# EAGLE board BMS-HVver3 (EAGLE 6.6.0), part 1 of 2
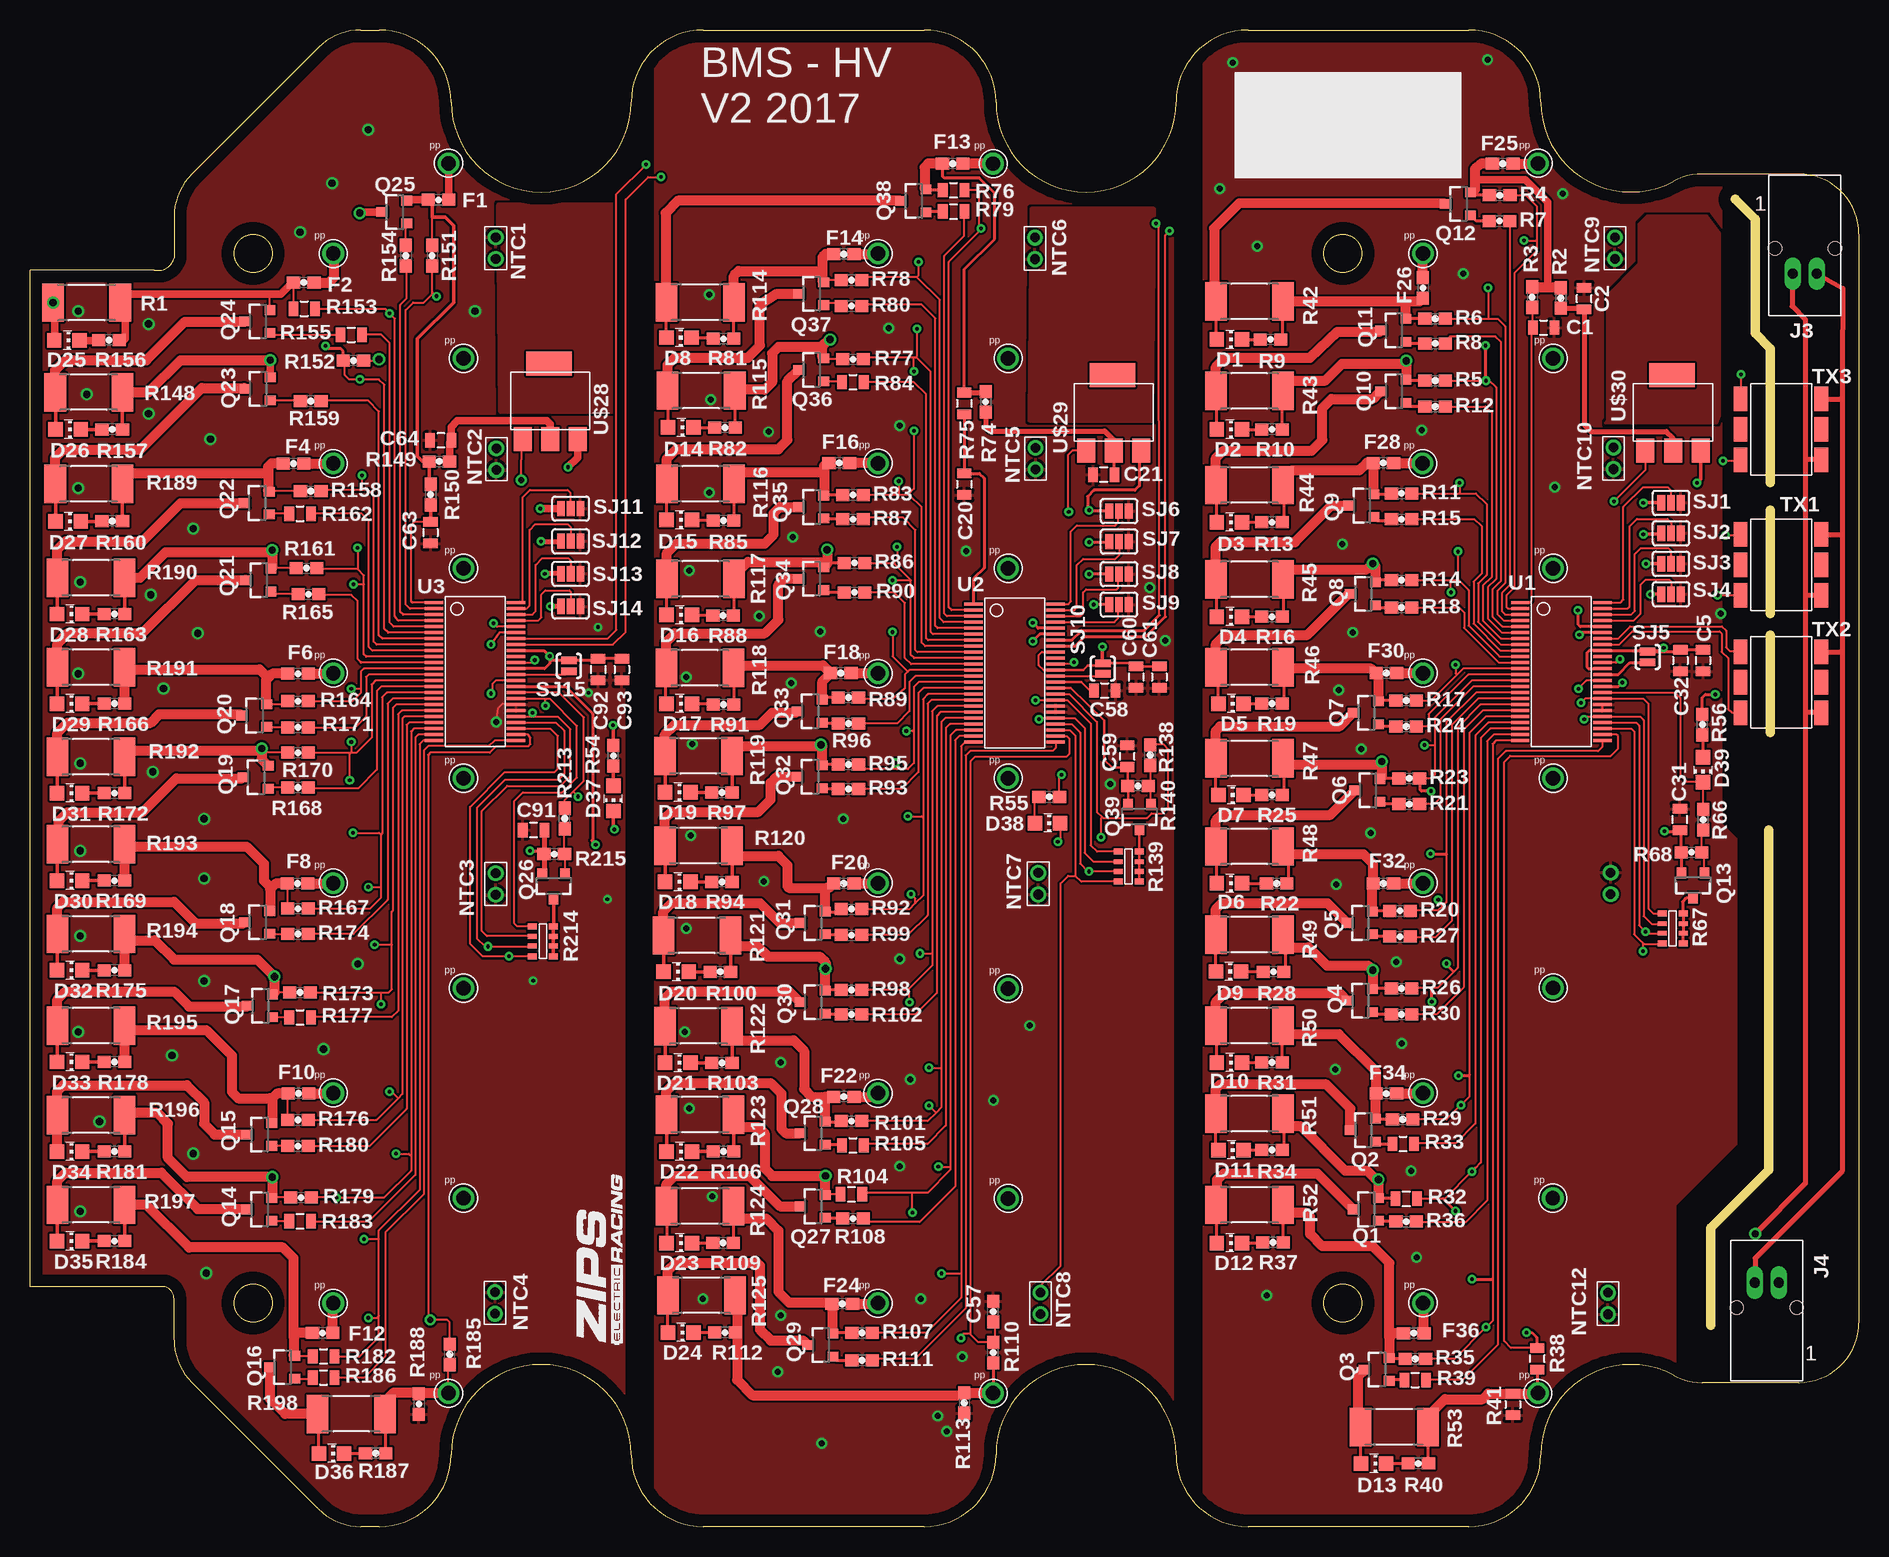
[diagram p3: board, top side]
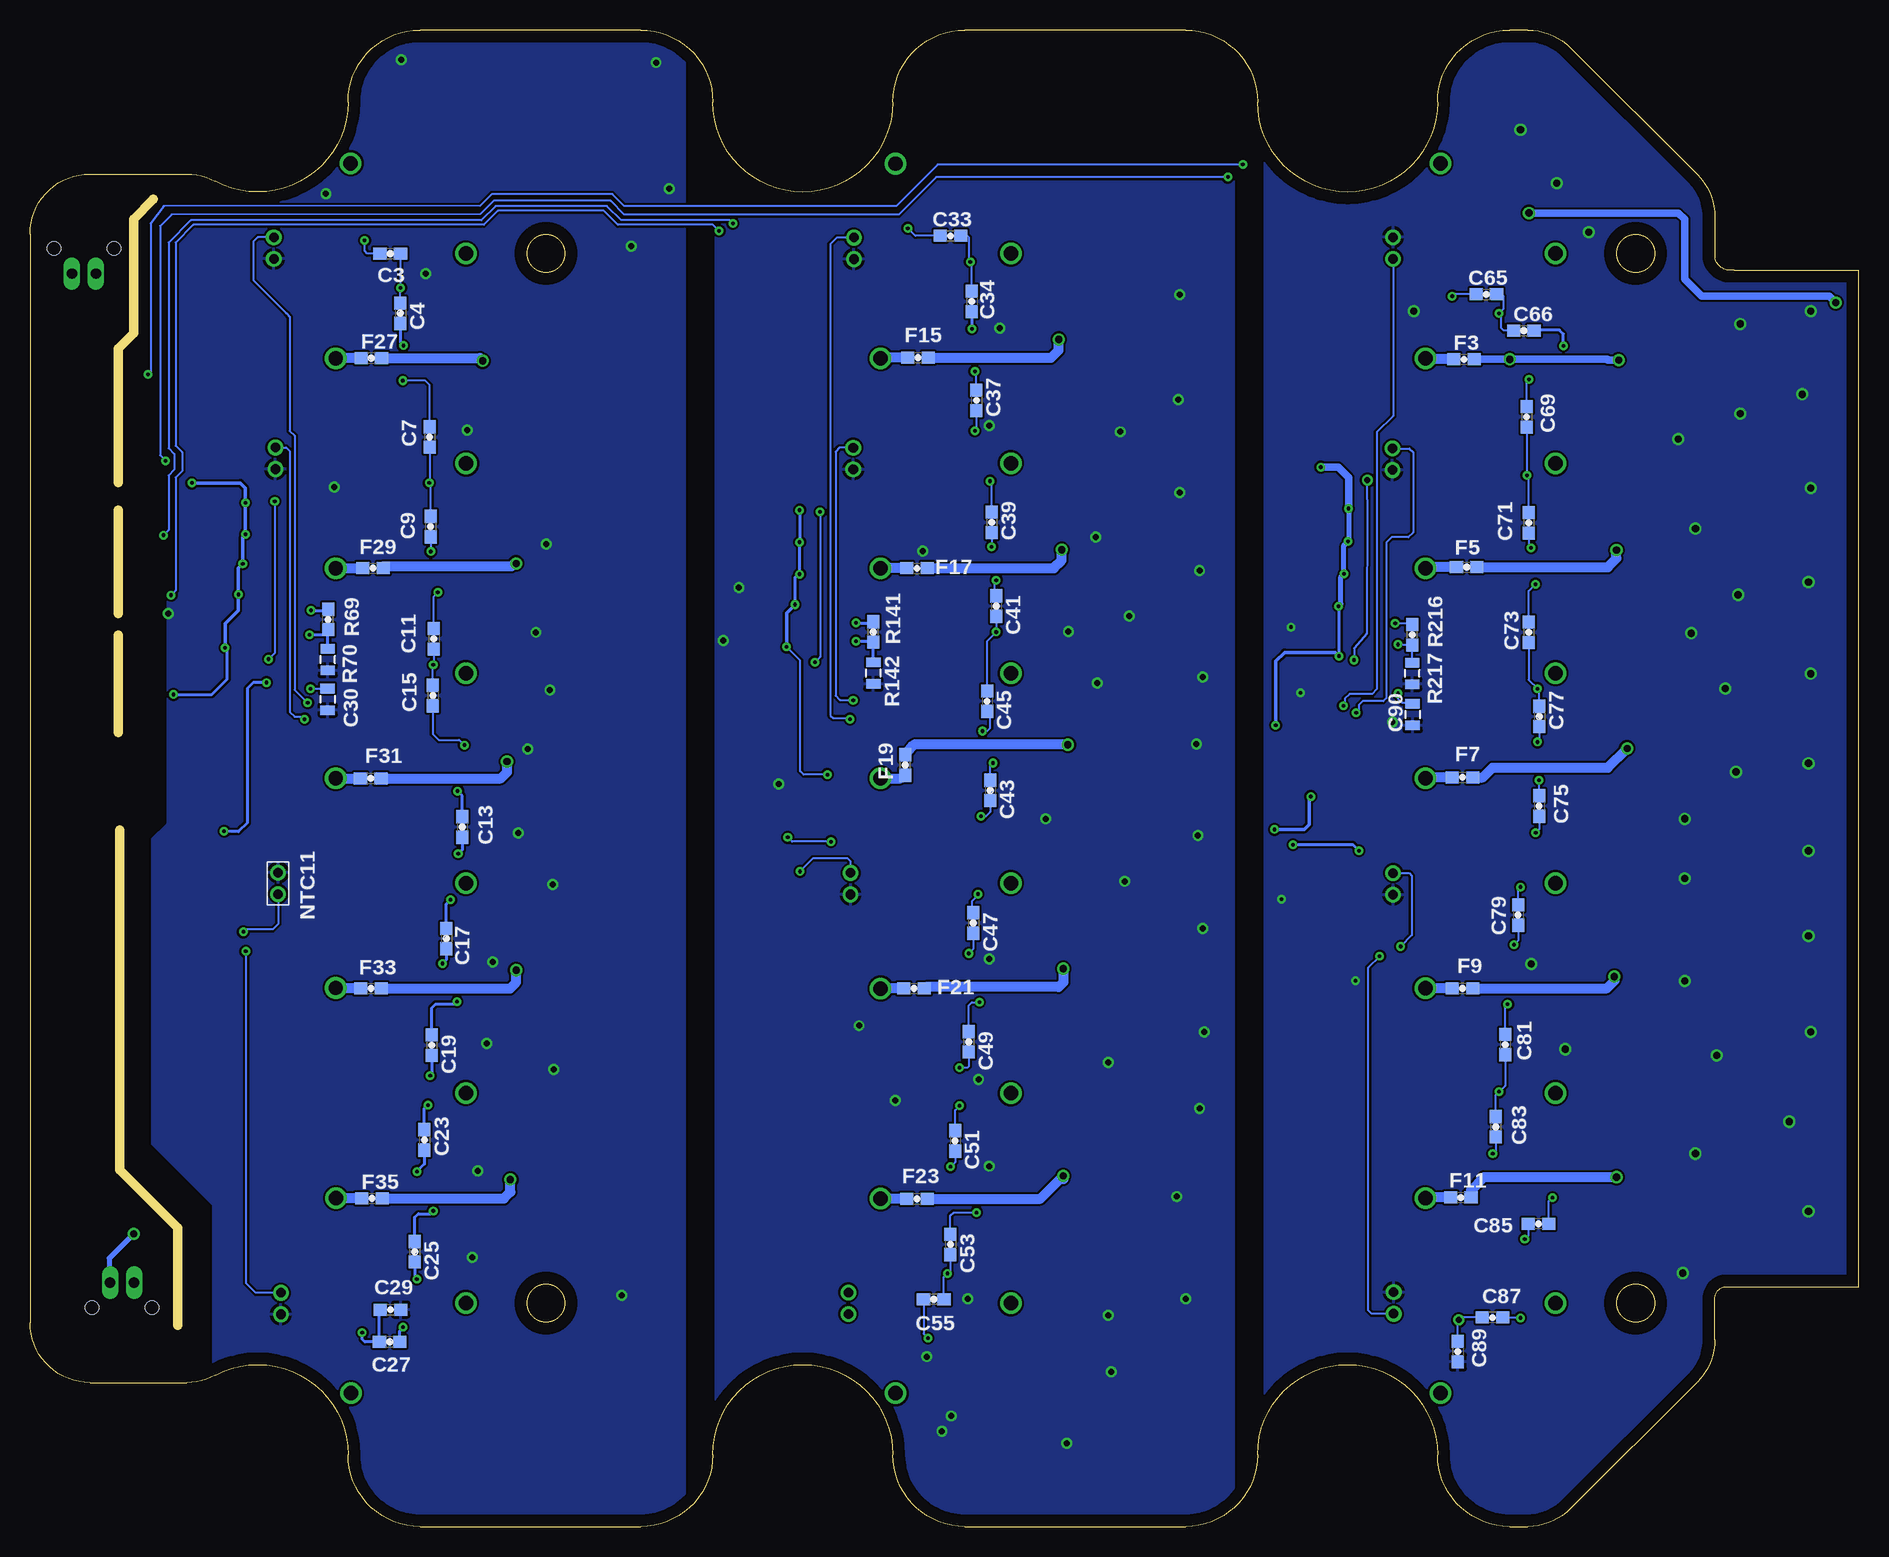
[diagram p4: board, bottom side, seen from below]

Size 152.4 x 124.75 mm. Coordinates in mm from the lower left corner, seen from the top.
Outline: 145.03,87.01 145.03,98.19 143.76,99.46 143.76,108.98 142.11,110.63
Outline: 145.03,84.73 145.03,76.09
Outline: 145.03,74.31 145.03,66.19
Outline: 140.08,16.78 140.08,24.91 144.91,29.74 144.91,58.06
Outline: 152.4,107.75 152.4,17 arc-90 147.4,12 139.34,12 arc-28 136.96,12.6 arc118 125.9,6 arc-90 119.9,0 101.5,0 arc-90 95.5,6 arc180 80.5,6 arc-90 74.5,0 56.1,0 arc-90 50.1,6 arc180 35.1,6 arc-90 29.1,0 27.57,0 arc-45 24.04,1.46 13.46,12.03 arc-45 12,15.57 12,19 arc90 11,20 0,20 0,104.75 10.37,104.75 arc90 12,105.75 12,109.18 arc-45 13.46,112.72 24.04,123.29 arc-45 27.57,124.75 29.1,124.75 arc-90 35.1,118.75 arc180 50.1,118.75 arc-90 56.1,124.75 74.5,124.75 arc-90 80.5,118.75 arc180 95.5,118.75 arc-90 101.5,124.75 119.9,124.75 arc-90 125.9,118.75 arc118 136.96,112.15 arc-28 139.34,112.75 147.4,112.75 arc-90 152.4,107.75
Outline: circle at 109.4,106.12 radius 1.59
Outline: circle at 109.4,18.62 radius 1.59
Outline: circle at 18.6,18.62 radius 1.59
Outline: circle at 18.6,106.12 radius 1.59
Copper layers (1*16): Top 0.035mm / dielectric 1.5mm / Bottom 0.035mm
Design rules "default *": minimum track width 7mil, minimum drill 12mil, track to track 7mil, track to pad 7mil, pad to pad 7mil, via to via 7mil, smd to smd 7mil, copper to edge 40mil, drill to drill 8mil, minimum pad ring 10mil, minimum via ring 8mil, stop-mask expansion 4mil, vias tented up to drill 0mil, thermal gap 10mil

## Footprints (pad centres in the part's own frame; a part is rotated, then mirrored left to right if it is on the bottom)
0805 = smd 0.8 x 1.2: 1 -0.9,0; 2 0.9,0
0603 = smd 1.1 x 1: 1 -0.85,0; 2 0.85,0
CHIP_LED0805 = smd 1.2 x 1.2: A 0,-1.05; C 0,1.05
S02B-PASK-2(LF)(SN) = drill 0.85 long: 1 -1,0; 2 1,0 | hole 1.1: -2.5,2.1; 2.5,2.1
103JT-025 = drill 0.8: 1 -0.9,0; 2 0.9,0
SOT23 = smd 0.8 x 0.9: 1 -0.95,-1; 2 0.95,-1; 3 0,1.1
R2512 = smd 1.8 x 3.2: 1 -2.8,0; 2 2.8,0
MNR14 = smd 0.5 x 0.75: 1 -1.25,-0.9; 4 1.25,-0.9; 5 1.25,0.85; 8 -1.25,0.85 | smd 0.4 x 0.75: 2 -0.4,-0.9; 3 0.4,-0.9; 6 0.4,0.85; 7 -0.4,0.85
PAD-JUMPER-3-NO_YES_SILK = smd 0.635 x 1.27: 1 -0.813,0; 2 0,0; 3 0.813,0
PAD-JUMPER-2-NO_YES_SILK = smd 0.635 x 1.27: 1 -0.45,0; 2 0.45,0
PE-68386NLT = smd 1.143 x 2.032: 1 -3.378,2.54; 2 -3.378,0; 3 -3.378,-2.54; 4 3.353,-2.54; 5 3.353,0; 6 3.353,2.54
SSOP-48 = smd 0.25 x 1.524: 1 -5.75,-3.421; 2 -5.25,-3.421; 3 -4.75,-3.421; 4 -4.25,-3.421; 5 -3.75,-3.421; 6 -3.25,-3.421; 7 -2.75,-3.421; 8 -2.25,-3.421; 9 -1.75,-3.421; 10 -1.25,-3.421; 11 -0.75,-3.421; 12 -0.25,-3.421; 13 0.25,-3.421; 14 0.75,-3.421; 15 1.25,-3.421; 16 1.75,-3.421; 17 2.25,-3.421; 18 2.75,-3.421; 19 3.25,-3.421; 20 3.75,-3.421; 21 4.25,-3.421; 22 4.75,-3.421; 23 5.25,-3.421; 24 5.75,-3.421; 25 5.75,3.421; 26 5.25,3.421; 27 4.75,3.421; 28 4.25,3.421; 29 3.75,3.421; 30 3.25,3.421; 31 2.75,3.421; 32 2.25,3.421; 33 1.75,3.421; 34 1.25,3.421; 35 0.75,3.421; 36 0.25,3.421; 37 -0.25,3.421; 38 -0.75,3.421; 39 -1.25,3.421; 40 -1.75,3.421; 41 -2.25,3.421; 42 -2.75,3.421; 43 -3.25,3.421; 44 -3.75,3.421; 45 -4.25,3.421; 46 -4.75,3.421; 47 -5.25,3.421; 48 -5.75,3.421
POGOPIN = drill 1.2: 1 0,0
SOT223 = smd 1.5 x 2: P$1 0,0; P$2 2.3,0; P$3 4.6,0 | smd 3.8 x 2: P$4 2.2,6.3

## Placement (x,y rotation side)
C1  0.1UF  [0805]  126.14,99.94 0 top
C2  0.1UF  [0805]  129.51,102.35 90 top
C3  10NF  [0603]  122.38,106.11 0 bottom
C4  10NF  [0603]  121.54,101.14 270 bottom
C5  1UF  [0805]  139.42,72.18 270 top
C7  10NF  [0603]  119.1,90.82 270 bottom
C9  10NF  [0603]  119.02,83.36 270 bottom
C11  10NF  [0603]  118.75,74.01 270 bottom
C13  10NF  [0603]  116.38,58.31 270 bottom
C15  10NF  [0603]  118.82,69.27 270 bottom
C17  10NF  [0603]  117.7,49.01 270 bottom
C19  10NF  [0603]  118.92,40.12 270 bottom
C20  0.1UF  [0805]  77.85,86.89 270 top
C21  0.1UF  [0805]  89.48,87.67 180 top
C23  10NF  [0603]  119.53,32.23 270 bottom
C25  10NF  [0603]  120.35,22.9 270 bottom
C27  10NF  [0603]  122.43,15.38 180 bottom
C29  10NF  [0603]  122.35,18.08 0 bottom
C30  1UF  [0805]  127.6,68.95 270 bottom
C31  1UF  [0805]  137.49,58.93 90 top
C32  1UF  [0805]  137.53,72.19 270 top
C33  10NF  [0603]  75.69,107.59 0 bottom
C34  10NF  [0603]  73.91,102.13 270 bottom
C37  10NF  [0603]  73.53,93.87 270 bottom
C39  10NF  [0603]  72.26,83.71 270 bottom
C41  10NF  [0603]  71.88,76.73 270 bottom
C43  10NF  [0603]  72.39,61.36 270 bottom
C45  10NF  [0603]  72.64,68.8 270 bottom
C47  10NF  [0603]  73.79,50.31 270 bottom
C49  10NF  [0603]  74.17,40.4 270 bottom
C51  10NF  [0603]  75.31,32.15 270 bottom
C53  10NF  [0603]  75.69,23.51 270 bottom
C55  10NF  [0603]  77.09,18.94 180 bottom
C57  10NF  [0603]  80.26,17.92 90 top
C58  1UF  [0805]  89.56,69.69 0 top
C59  1UF  [0805]  91.44,64.22 90 top
C60  1UF  [0805]  92.18,70.81 270 top
C61  1UF  [0805]  94.12,70.81 270 top
C63  0.1UF  [0805]  33.38,82.85 270 top
C64  0.1UF  [0805]  34.24,90.54 180 top
C65  10NF  [0603]  31.04,102.71 0 bottom
C66  10NF  [0603]  27.91,99.69 0 bottom
C69  10NF  [0603]  27.69,92.5 270 bottom
C71  10NF  [0603]  27.51,83.66 270 bottom
C73  10NF  [0603]  27.51,74.54 270 bottom
C75  10NF  [0603]  26.64,60.06 270 bottom
C77  10NF  [0603]  26.62,67.53 270 bottom
C79  10NF  [0603]  28.4,50.97 270 bottom
C81  10NF  [0603]  29.46,40.18 270 bottom
C83  10NF  [0603]  30.25,33.32 270 bottom
C85  10NF  [0603]  26.7,25.24 180 bottom
C87  10NF  [0603]  30.53,17.42 180 bottom
C89  10NF  [0603]  33.41,14.58 270 bottom
C90  1UF  [0805]  37.19,67.68 270 bottom
C91  1UF  [0805]  41.96,58.06 180 top
C92  1UF  [0805]  47.35,71.44 270 top
C93  1UF  [0805]  49.33,71.44 270 top
D1  LED_RED  [CHIP_LED0805]  99.95,98.95 270 top
D2  LED_RED  [CHIP_LED0805]  99.95,91.46 270 top
D3  LED_RED  [CHIP_LED0805]  99.95,83.71 270 top
D4  LED_RED  [CHIP_LED0805]  99.95,75.84 270 top
D5  LED_RED  [CHIP_LED0805]  100.08,68.6 270 top
D6  LED_RED  [CHIP_LED0805]  99.95,53.61 270 top
D7  LED_RED  [CHIP_LED0805]  100.08,60.98 270 top
D8  LED_RED  [CHIP_LED0805]  54.08,99.1 270 top
D9  LED_RED  [CHIP_LED0805]  99.87,46.27 270 top
D10  LED_RED  [CHIP_LED0805]  99.95,38.68 270 top
D11  LED_RED  [CHIP_LED0805]  100.08,31.39 270 top
D12  LED_RED  [CHIP_LED0805]  99.95,23.64 270 top
D13  LED_RED  [CHIP_LED0805]  111.96,5.25 270 top
D14  LED_RED  [CHIP_LED0805]  54.23,91.61 270 top
D15  LED_RED  [CHIP_LED0805]  54.1,83.91 270 top
D16  LED_RED  [CHIP_LED0805]  54.1,75.99 270 top
D17  LED_RED  [CHIP_LED0805]  54.1,68.6 270 top
D18  LED_RED  [CHIP_LED0805]  53.98,53.74 270 top
D19  LED_RED  [CHIP_LED0805]  53.98,61.21 270 top
D20  LED_RED  [CHIP_LED0805]  53.85,46.25 270 top
D21  LED_RED  [CHIP_LED0805]  53.98,38.65 270 top
D22  LED_RED  [CHIP_LED0805]  54.1,31.26 270 top
D23  LED_RED  [CHIP_LED0805]  54.1,23.64 270 top
D24  LED_RED  [CHIP_LED0805]  54.23,16.17 270 top
D25  LED_RED  [CHIP_LED0805]  3.07,98.87 270 top
D26  LED_RED  [CHIP_LED0805]  3.17,91.46 270 top
D27  LED_RED  [CHIP_LED0805]  3.17,83.79 270 top
D28  LED_RED  [CHIP_LED0805]  3.3,76.07 270 top
D29  LED_RED  [CHIP_LED0805]  3.3,68.6 270 top
D30  LED_RED  [CHIP_LED0805]  3.3,53.84 270 top
D31  LED_RED  [CHIP_LED0805]  3.3,61.13 270 top
D32  LED_RED  [CHIP_LED0805]  3.3,46.37 270 top
D33  LED_RED  [CHIP_LED0805]  3.3,38.73 270 top
D34  LED_RED  [CHIP_LED0805]  3.3,31.26 270 top
D35  LED_RED  [CHIP_LED0805]  3.3,23.79 270 top
D36  LED_RED  [CHIP_LED0805]  25.12,6.09 270 top
D37  LED_AMBER  [CHIP_LED0805]  48.62,60.7 180 top
D38  LED_AMBER  [CHIP_LED0805]  84.79,58.64 270 top
D39  LED_AMBER  [CHIP_LED0805]  139.42,63.09 180 top
F1  FUSE_750MA_63V_0603  [0603]  34.04,110.58 180 top
F2  FUSE_750MA_63V_0603  [0603]  22.81,103.7 180 top
F3  FUSE_750MA_63V_0603  [0603]  32.89,97.3 0 bottom
F4  FUSE_750MA_63V_0603  [0603]  21.96,88.61 180 top
F5  FUSE_750MA_63V_0603  [0603]  32.68,79.98 0 bottom
F6  FUSE_750MA_63V_0603  [0603]  22.33,71.09 180 top
F7  FUSE_750MA_63V_0603  [0603]  33.03,62.45 0 bottom
F8  FUSE_750MA_63V_0603  [0603]  22.29,53.6 180 top
F9  FUSE_750MA_63V_0603  [0603]  33.03,44.86 0 bottom
F10  FUSE_750MA_63V_0603  [0603]  22.38,36.1 180 top
F11  FUSE_750MA_63V_0603  [0603]  33.16,27.42 0 bottom
F12  FUSE_750MA_63V_0603  [0603]  24.38,16.13 180 top
F13  FUSE_750MA_63V_0603  [0603]  76.89,113.61 180 top
F14  FUSE_750MA_63V_0603  [0603]  67.82,106.06 180 top
F15  FUSE_750MA_63V_0603  [0603]  78.4,97.43 0 bottom
F16  FUSE_750MA_63V_0603  [0603]  67.44,88.66 180 top
F17  FUSE_750MA_63V_0603  [0603]  78.49,79.88 0 bottom
F18  FUSE_750MA_63V_0603  [0603]  67.56,71.14 180 top
F19  FUSE_750MA_63V_0603  [0603]  79.46,63.48 90 bottom
F20  FUSE_750MA_63V_0603  [0603]  67.82,53.61 180 top
F21  FUSE_750MA_63V_0603  [0603]  78.74,44.85 0 bottom
F22  FUSE_750MA_63V_0603  [0603]  67.82,35.83 180 top
F23  FUSE_750MA_63V_0603  [0603]  78.49,27.32 0 bottom
F24  FUSE_750MA_63V_0603  [0603]  67.69,18.56 180 top
F25  FUSE_750MA_63V_0603  [0603]  122.73,113.61 180 top
F26  FUSE_750MA_63V_0603  [0603]  116.08,103.24 270 top
F27  FUSE_750MA_63V_0603  [0603]  123.95,97.4 0 bottom
F28  FUSE_750MA_63V_0603  [0603]  112.78,88.66 180 top
F29  FUSE_750MA_63V_0603  [0603]  123.83,79.9 0 bottom
F30  FUSE_750MA_63V_0603  [0603]  113.03,71.14 180 top
F31  FUSE_750MA_63V_0603  [0603]  124,62.38 0 bottom
F32  FUSE_750MA_63V_0603  [0603]  112.78,53.61 180 top
F33  FUSE_750MA_63V_0603  [0603]  123.99,44.85 0 bottom
F34  FUSE_750MA_63V_0603  [0603]  113.03,36.09 180 top
F35  FUSE_750MA_63V_0603  [0603]  123.9,27.35 0 bottom
F36  FUSE_750MA_63V_0603  [0603]  115.32,16.12 180 top
J3  M2S02B-PASK-2(LF)(SN)  [S02B-PASK-2(LF)(SN)]  147.9,104.44 0 top
J4  M2S02B-PASK-2(LF)(SN)  [S02B-PASK-2(LF)(SN)]  144.73,20.34 180 top
NTC1  103JT-025  [103JT-025]  38.81,106.57 270 top
NTC2  103JT-025  [103JT-025]  38.86,88.97 90 top
NTC3  103JT-025  [103JT-025]  38.81,53.56 90 top
NTC4  103JT-025  [103JT-025]  38.76,18.64 270 top
NTC5  103JT-025  [103JT-025]  83.79,89.02 90 top
NTC6  103JT-025  [103JT-025]  83.74,106.55 90 top
NTC7  103JT-025  [103JT-025]  84.02,53.59 90 top
NTC8  103JT-025  [103JT-025]  84.2,18.61 90 top
NTC9  103JT-025  [103JT-025]  132.08,106.57 90 top
NTC10  103JT-025  [103JT-025]  131.95,89.05 90 top
NTC11  103JT-025  [103JT-025]  131.72,53.61 270 bottom
NTC12  103JT-025  [103JT-025]  131.5,18.59 90 top
Q1  BSS308PE  [SOT23]  111.38,26.43 90 top
Q2  BSS308PE  [SOT23]  111.12,33.04 90 top
Q3  BSS308PE  [SOT23]  112.27,13.1 90 top
Q4  BSS308PE  [SOT23]  110.87,43.83 90 top
Q5  BSS308PE  [SOT23]  110.87,50.31 90 top
Q6  BSS308PE  [SOT23]  111.51,61.36 90 top
Q7  BSS308PE  [SOT23]  111.38,67.84 90 top
Q8  BSS308PE  [SOT23]  111.12,77.74 90 top
Q9  BSS308PE  [SOT23]  111,85.11 90 top
Q10  BSS308PE  [SOT23]  113.67,94.63 90 top
Q11  BSS308PE  [SOT23]  113.67,99.71 90 top
Q12  BSS308PE  [SOT23]  119.05,110.25 90 top
Q13  BSS308PE  [SOT23]  138.58,53.48 180 top
Q14  BSS308PE  [SOT23]  19.15,26.43 90 top
Q15  BSS308PE  [SOT23]  19.15,32.68 90 top
Q16  BSS308PE  [SOT23]  21.06,13.28 90 top
Q17  BSS308PE  [SOT23]  19.2,43.4 90 top
Q18  BSS308PE  [SOT23]  18.97,50.36 90 top
Q19  BSS308PE  [SOT23]  18.85,62.45 90 top
Q20  BSS308PE  [SOT23]  18.72,67.61 90 top
Q21  BSS308PE  [SOT23]  19.08,78.89 90 top
Q22  BSS308PE  [SOT23]  18.95,85.31 90 top
Q23  BSS308PE  [SOT23]  19.02,94.84 90 top
Q24  BSS308PE  [SOT23]  19,100.45 90 top
Q25  BSS308PE  [SOT23]  30.4,109.57 90 top
Q26  BSS308PE  [SOT23]  43.64,53.41 180 top
Q27  BSS308PE  [SOT23]  65.28,26.69 90 top
Q28  BSS308PE  [SOT23]  65.28,32.78 90 top
Q29  BSS308PE  [SOT23]  65.91,15.13 90 top
Q30  BSS308PE  [SOT23]  65.28,43.71 90 top
Q31  BSS308PE  [SOT23]  65.28,50.31 90 top
Q32  BSS308PE  [SOT23]  65.02,62.5 90 top
Q33  BSS308PE  [SOT23]  65.02,67.96 90 top
Q34  BSS308PE  [SOT23]  65.15,79.01 90 top
Q35  BSS308PE  [SOT23]  65.15,84.98 90 top
Q36  BSS308PE  [SOT23]  65.15,96.41 90 top
Q37  BSS308PE  [SOT23]  65.15,102.76 90 top
Q38  BSS308PE  [SOT23]  73.66,110.51 90 top
Q39  BSS308PE  [SOT23]  92.46,59.2 180 top
R1  [R2512]  4.72,102.02 180 top
R2  100  [0603]  127.56,102.41 270 top
R3  100  [0603]  125.17,102.48 270 top
R4  100  [0603]  122.48,110.97 0 top
R5  100  [0603]  117.09,95.52 0 top
R6  100  [0603]  117.09,100.68 0 top
R7  3.3K  [0603]  122.45,108.83 0 top
R8  3.3K  [0603]  117.09,98.62 0 top
R9  475  [0603]  103.38,98.95 180 top
R10  475  [0603]  103.5,91.46 180 top
R11  100  [0603]  114.3,86.12 0 top
R12  3.3K  [0603]  117.09,93.36 0 top
R13  475  [0603]  103.5,83.71 180 top
R14  100  [0603]  114.3,78.89 0 top
R15  3.3K  [0603]  114.3,83.97 0 top
R16  475  [0603]  103.5,75.84 180 top
R17  100  [0603]  114.68,68.85 0 top
R18  3.3K  [0603]  114.3,76.6 0 top
R19  475  [0603]  103.5,68.6 180 top
R20  100  [0603]  114.17,51.33 0 top
R21  3.3K  [0603]  114.94,60.22 0 top
R22  475  [0603]  103.89,53.61 180 top
R23  100  [0603]  114.94,62.38 0 top
R24  3.3K  [0603]  114.68,66.69 0 top
R25  475  [0603]  103.5,60.98 180 top
R26  100  [0603]  114.3,44.85 0 top
R27  3.3K  [0603]  114.17,49.17 0 top
R28  475  [0603]  103.63,46.25 180 top
R29  100  [0603]  114.39,33.93 0 top
R30  3.3K  [0603]  114.3,42.69 0 top
R31  475  [0603]  103.5,38.68 180 top
R32  100  [0805]  114.68,27.32 0 top
R33  3.3K  [0805]  114.43,31.89 0 top
R34  475  [0603]  103.5,31.39 180 top
R35  100  [0603]  115.44,13.99 0 top
R36  3.3K  [0603]  114.68,25.42 0 top
R37  475  [0603]  103.58,23.69 180 top
R38  100  [0805]  125.6,13.99 90 top
R39  3.3K  [0805]  115.44,12.21 0 top
R40  475  [0603]  115.7,5.25 180 top
R41  0  [0805]  123.57,10.18 270 top
R42  [R2512]  101.63,102.13 180 top
R43  [R2512]  101.63,94.66 180 top
R44  [R2512]  101.63,86.81 180 top
R45  [R2512]  101.63,78.96 180 top
R46  [R2512]  101.63,71.62 180 top
R47  [R2512]  101.63,64.03 180 top
R48  [R2512]  101.63,56.69 180 top
R49  [R2512]  101.63,49.34 180 top
R50  [R2512]  101.63,41.75 180 top
R51  [R2512]  101.63,34.41 180 top
R52  [R2512]  101.63,26.81 180 top
R53  [R2512]  113.69,8.3 180 top
R54  1k  [0603]  48.62,64.25 90 top
R55  1k  [0603]  84.94,60.83 0 top
R56  1k  [0603]  139.37,66.85 90 top
R66  1K  [0603]  139.45,58.92 90 top
R67  10K  [MNR14]  136.91,49.85 270 top
R68  100K  [0603]  138.46,56.2 180 top
R69  1.2K  [0603]  127.56,75.61 90 bottom
R70  787  [0805]  127.58,72.27 90 bottom
R74  100  [0603]  79.63,93.74 270 top
R75  100  [0805]  77.85,93.62 270 top
R76  100  [0805]  76.96,111.4 0 top
R77  100  [0603]  68.58,97.3 0 top
R78  100  [0603]  68.45,103.9 0 top
R79  3.3K  [0805]  76.96,109.62 0 top
R80  3.3K  [0603]  68.45,101.75 0 top
R81  475  [0603]  57.79,99 180 top
R82  475  [0603]  57.91,91.61 180 top
R83  100  [0603]  68.58,86 0 top
R84  3.3K  [0805]  68.58,95.4 0 top
R85  475  [0603]  57.79,83.86 180 top
R86  100  [0603]  68.71,80.33 0 top
R87  3.3K  [0603]  68.58,83.97 0 top
R88  475  [0603]  57.76,75.94 180 top
R89  100  [0603]  68.2,69.11 0 top
R90  3.3K  [0603]  68.71,77.87 0 top
R91  475  [0603]  57.79,68.52 180 top
R92  100  [0603]  68.45,51.48 0 top
R93  3.3K  [0603]  68.2,61.49 0 top
R94  475  [0603]  57.66,53.74 180 top
R95  100  [0603]  68.2,63.52 0 top
R96  3.3K  [0603]  68.2,66.95 0 top
R97  475  [0603]  57.66,61.18 180 top
R98  100  [0603]  68.45,44.72 0 top
R99  3.3K  [0603]  68.45,49.29 0 top
R100  475  [0603]  57.53,46.25 180 top
R101  100  [0603]  68.45,33.8 0 top
R102  3.3K  [0603]  68.45,42.69 0 top
R103  475  [0603]  57.66,38.65 180 top
R104  100  [0805]  68.45,27.7 0 top
R105  3.3K  [0805]  68.58,31.77 0 top
R106  475  [0603]  57.79,31.26 180 top
R107  100  [0603]  69.34,16.15 0 top
R108  3.3K  [0603]  68.58,25.67 0 top
R109  475  [0603]  57.76,23.64 180 top
R110  100  [0603]  80.26,14.5 90 top
R111  3.3K  [0603]  69.34,13.86 0 top
R112  475  [0603]  57.91,16.17 180 top
R113  0  [0603]  77.85,10.3 270 top
R114  [R2512]  55.85,102.05 180 top
R115  [R2512]  55.93,94.68 180 top
R116  [R2512]  55.88,86.91 180 top
R117  [R2512]  55.88,78.99 180 top
R118  [R2512]  55.83,71.57 180 top
R119  [R2512]  55.7,64.23 180 top
R120  [R2512]  55.7,56.76 180 top
R121  [R2512]  55.58,49.27 180 top
R122  [R2512]  55.7,41.72 180 top
R123  [R2512]  55.83,34.33 180 top
R124  [R2512]  55.83,26.71 180 top
R125  [R2512]  55.96,19.27 180 top
R138  1K  [0603]  93.34,64.31 90 top
R139  10K  [MNR14]  91.57,55.01 270 top
R140  100K  [0603]  92.33,61.74 180 top
R141  1.2K  [0603]  82.12,74.57 90 bottom
R142  787  [0805]  82.12,71.14 90 bottom
R148  [R2512]  4.9,94.56 180 top
R149  100  [0603]  34.11,88.79 0 top
R150  100  [0603]  33.38,86.02 270 top
R151  100  [0603]  33.5,105.94 270 top
R152  100  [0603]  26.95,97.2 180 top
R153  100  [0805]  22.86,101.52 0 top
R154  3.3K  [0603]  31.32,105.94 270 top
R155  3.3K  [0805]  26.77,99.33 0 top
R156  475  [0603]  6.58,98.9 180 top
R157  475  [0603]  6.86,91.46 180 top
R158  100  [0603]  23.39,86.3 0 top
R159  3.3K  [0603]  23.39,93.82 0 top
R160  475  [0603]  6.86,83.81 180 top
R161  100  [0603]  23.04,79.9 0 top
R162  3.3K  [0805]  22.5,84.42 0 top
R163  475  [0603]  7.04,76.07 180 top
R164  100  [0603]  22.33,68.8 0 top
R165  3.3K  [0603]  23.22,77.72 0 top
R166  475  [0603]  7.04,68.6 180 top
R167  100  [0603]  22.33,51.5 0 top
R168  3.3K  [0603]  22.33,61.61 0 top
R169  475  [0603]  7.04,53.84 180 top
R170  100  [0603]  22.33,64.51 0 top
R171  3.3K  [0603]  22.33,66.62 0 top
R172  475  [0603]  7.04,61.13 180 top
R173  100  [0603]  22.5,44.52 0 top
R174  3.3K  [0603]  22.33,49.4 0 top
R175  475  [0603]  7.04,46.37 180 top
R176  100  [0603]  22.33,33.9 0 top
R177  3.3K  [0805]  22.5,42.44 0 top
R178  475  [0603]  7.04,38.73 180 top
R179  100  [0603]  22.58,27.42 0 top
R180  3.3K  [0603]  22.33,31.72 0 top
R181  475  [0603]  7.04,31.26 180 top
R182  100  [0805]  24.46,14.19 0 top
R183  3.3K  [0805]  22.5,25.44 0 top
R184  475  [0603]  7.04,23.79 180 top
R185  100  [0603]  34.98,14.34 90 top
R186  3.3K  [0805]  24.46,12.41 0 top
R187  475  [0603]  28.8,6.11 180 top
R188  0  [0603]  32.41,10.2 270 top
R189  [R2512]  4.9,86.91 180 top
R190  [R2512]  5.08,79.09 180 top
R191  [R2512]  5.08,71.62 180 top
R192  [R2512]  5.08,64.15 180 top
R193  [R2512]  5.08,56.86 180 top
R194  [R2512]  5.08,49.4 180 top
R195  [R2512]  5.08,41.75 180 top
R196  [R2512]  5.08,34.28 180 top
R197  [R2512]  5.08,26.81 180 top
R198  [R2512]  26.77,9.39 180 top
R213  1K  [0603]  44.55,59.02 90 top
R214  10K  [MNR14]  42.77,48.79 270 top
R215  100K  [0603]  43.69,56.05 180 top
R216  1.2K  [0603]  37.21,74.34 90 bottom
R217  787  [0805]  37.21,71.11 90 bottom
SJ1  [PAD-JUMPER-3-NO_YES_SILK]  136.75,85.34 0 top
SJ2  [PAD-JUMPER-3-NO_YES_SILK]  136.75,82.8 0 top
SJ3  [PAD-JUMPER-3-NO_YES_SILK]  136.75,80.26 0 top
SJ4  [PAD-JUMPER-3-NO_YES_SILK]  136.75,77.72 0 top
SJ5  [PAD-JUMPER-2-NO_YES_SILK]  134.8,72.48 90 top
SJ6  [PAD-JUMPER-3-NO_YES_SILK]  90.75,84.65 0 top
SJ7  [PAD-JUMPER-3-NO_YES_SILK]  90.75,82.11 0 top
SJ8  [PAD-JUMPER-3-NO_YES_SILK]  90.75,79.39 0 top
SJ9  [PAD-JUMPER-3-NO_YES_SILK]  90.75,76.85 0 top
SJ10  [PAD-JUMPER-2-NO_YES_SILK]  89.41,71.52 90 top
SJ11  [PAD-JUMPER-3-NO_YES_SILK]  45.06,84.85 0 top
SJ12  [PAD-JUMPER-3-NO_YES_SILK]  45.06,82.14 0 top
SJ13  [PAD-JUMPER-3-NO_YES_SILK]  45.06,79.42 0 top